# EasyEDA Pro project 3SE_24_Power_Rune.eprj, board 深大PCB参考 (continued)
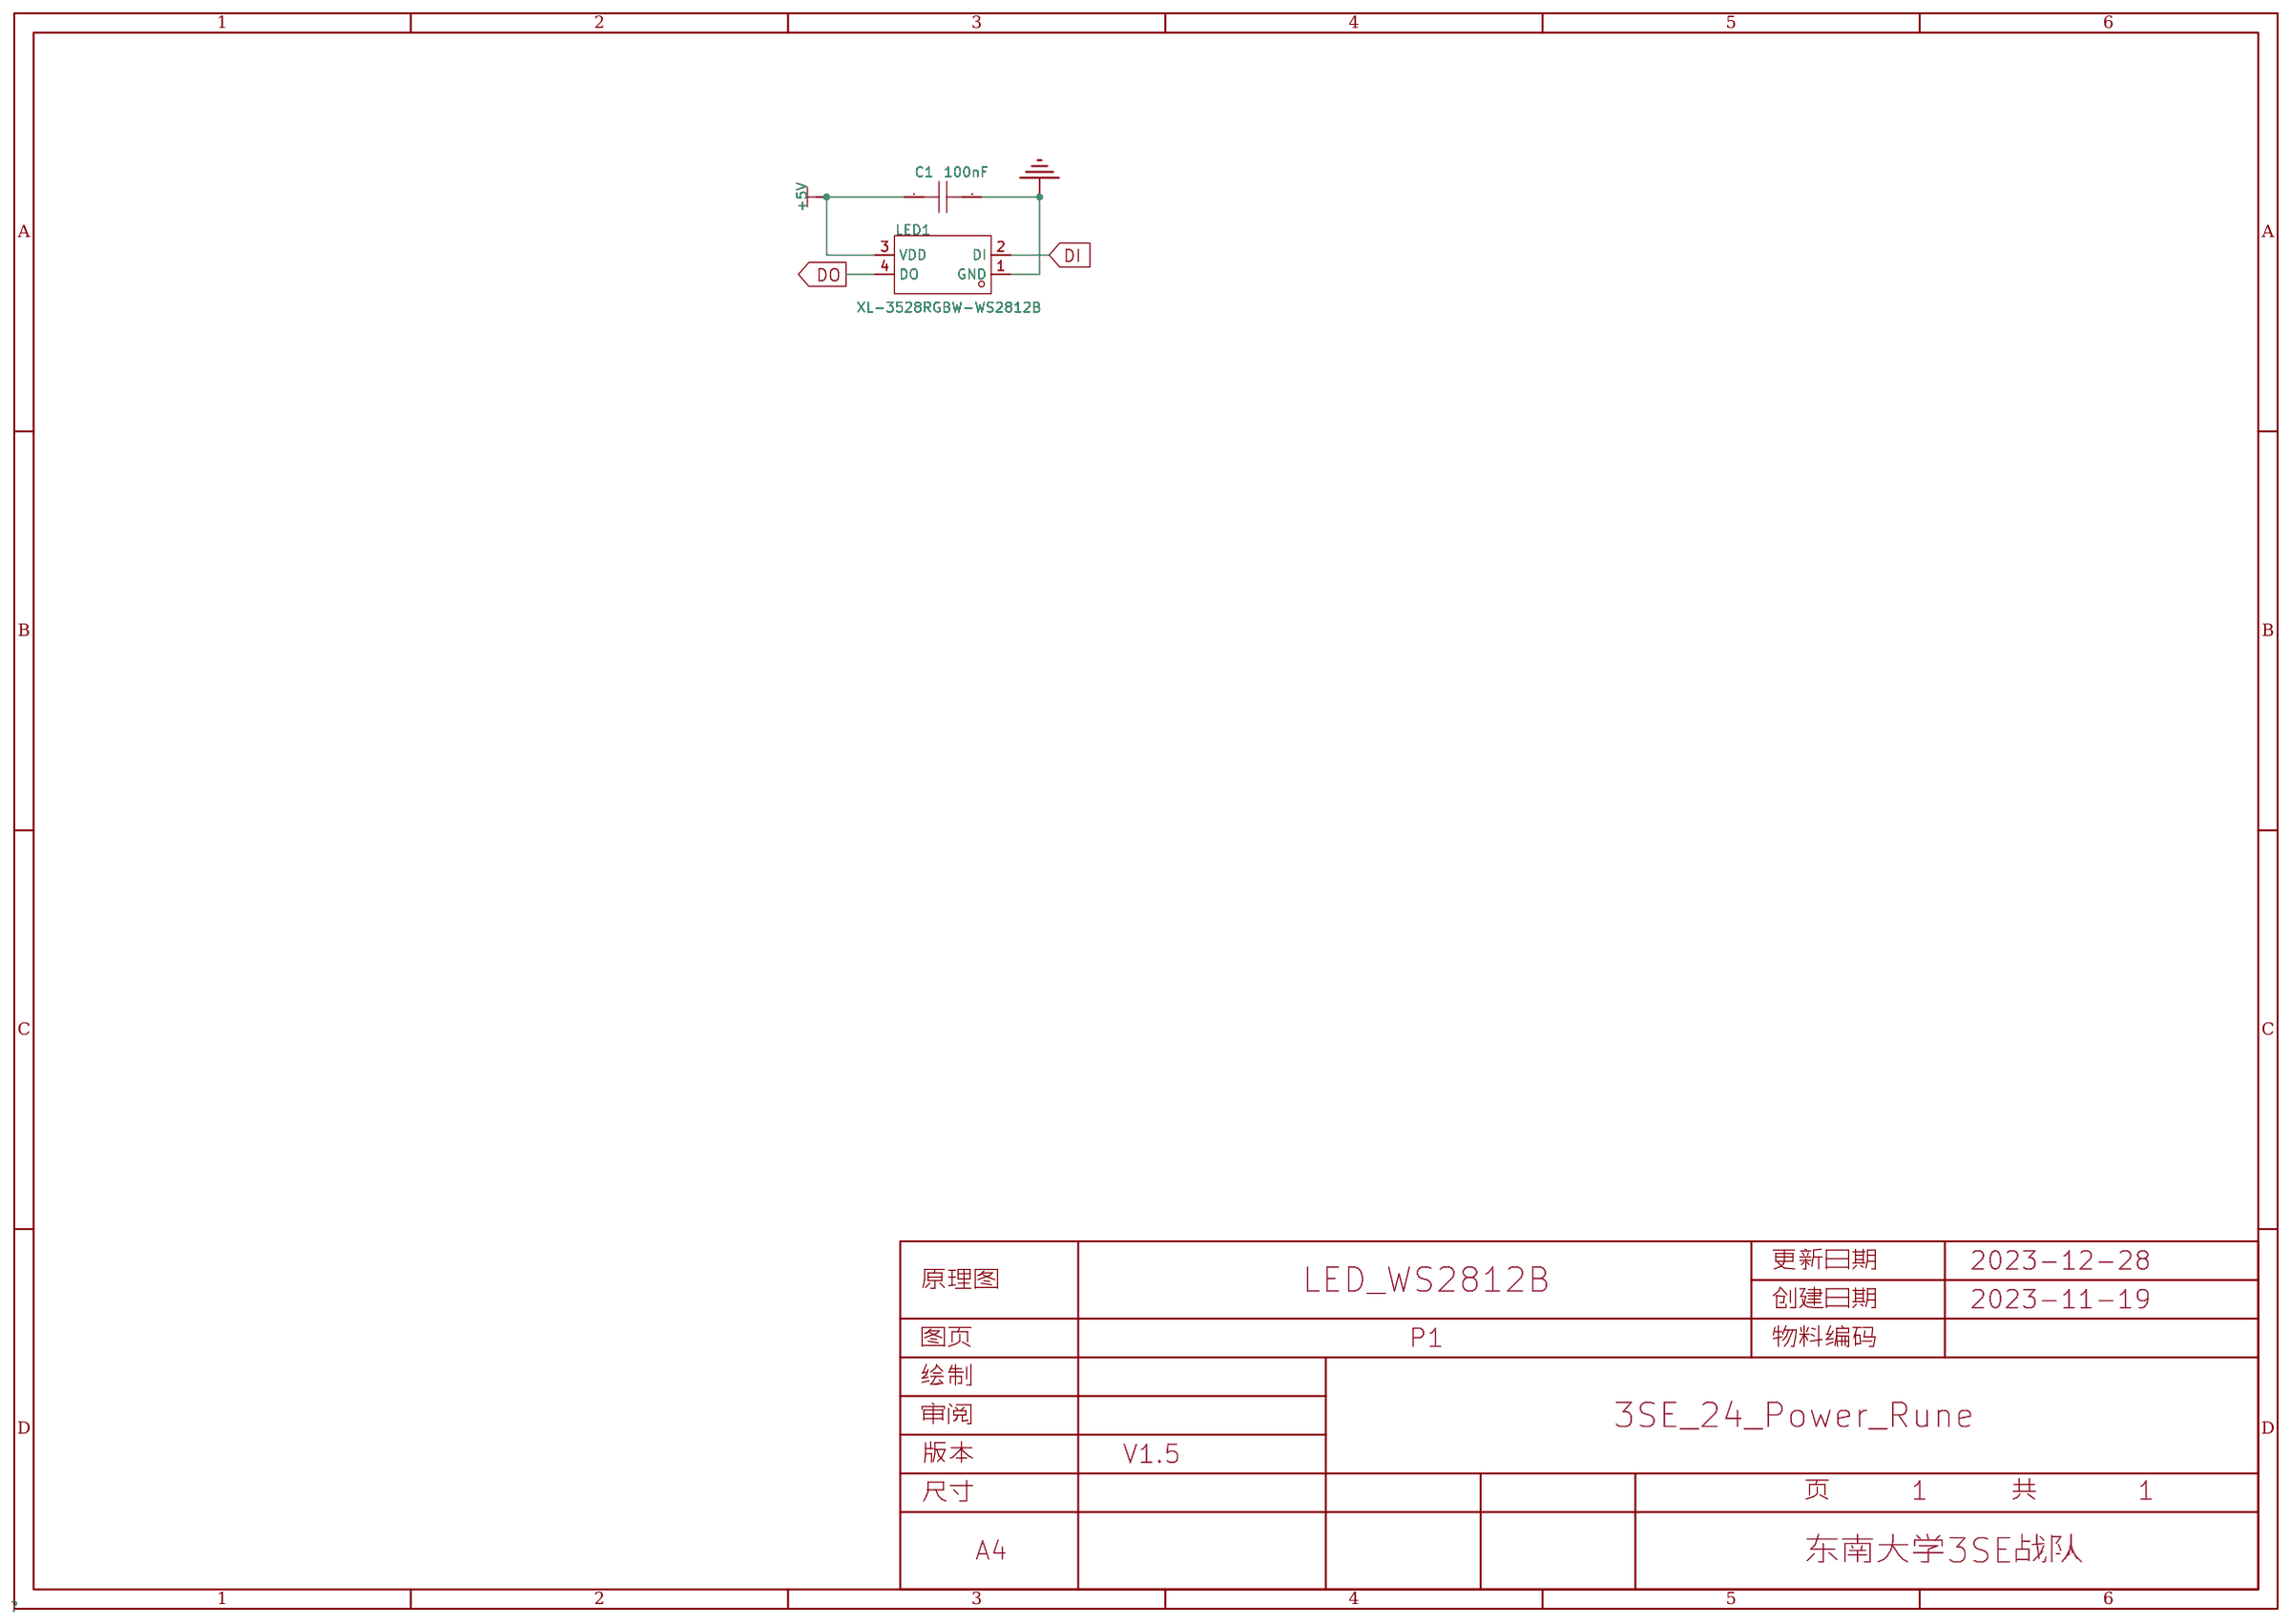
[diagram p0: schematic sheet]
## Placement (name value [footprint] x y rotation side) (continued)
J10  -  [GH1.25-LS-2P]  164.72 282.19 195 bottom
J11  -  [GH1.25-LS-2P]  161.42 296.93 195 bottom
J12  -  [GH1.25-LS-2P]  157.5 310.76 195 bottom
J13  -  [GH1.25-LS-2P]  154.05 325.25 195 bottom
J14  -  [XT30M]  27.81 216.15 270 bottom
J15  -  [XT30M]  27.81 173.74 90 bottom
J17  -  [XT30M]  341 194.69 90 bottom
J18  -  [GH1.25_12P]  340.74 214.25 270 bottom
NOREF  -  [Pad_ie460]  306.42 318.26 180 top
NOREF#2  -  [Pad_ie430]  274.52 102.17 270 top
NOREF#3  -  [Pad_ie452]  210.92 218.77 0 top
NOREF#4  -  [Pad_ie442]  157.92 218.77 90 top
NOREF#5  -  [Pad_ie441]  168.52 208.17 90 top
NOREF#6  -  [Pad_ie453]  221.52 229.47 0 top
NOREF#7  -  [Pad_ie425]  126.12 133.97 180 top
NOREF#8  -  [Pad_ie435]  200.32 176.37 270 top
NOREF#9  -  [Pad_ie447]  104.9 271.27 90 top
NOREF#10  -  [Pad_ie426]  136.72 144.57 180 top
NOREF#11  -  [Pad_ie421]  83.72 91.47 180 top
NOREF#12  -  [Pad_ie431]  264.16 112.4 270 top
NOREF#13  -  [Pad_ie420]  66.42 60.27 180 top
NOREF#14  -  [Pad_ie434]  184.42 192.27 0 top
NOREF#15  -  [Pad_ie432]  157.73 165.35 180 top
NOREF#16  -  [Pad_ie454]  232.12 239.97 0 top
NOREF#17  -  [Pad_ie449]  83.72 292.97 180 top
NOREF#18  -  [Pad_ie427]  147.32 155.07 180 top
NOREF#19  -  [Pad_ie439]  242.72 133.97 270 top
NOREF#20  -  [Pad_ie457]  264.16 272.03 0 top
NOREF#21  -  [Pad_ie429]  285.12 91.57 0 top
NOREF#22  -  [Pad_ie440]  253.32 123.37 270 top
NOREF#23  -  [Pad_ie461]  184.42 192.27 180 top
NOREF#24  -  [Pad_ie428]  302.42 60.27 180 top
NOREF#25  -  [Pad_ie456]  253.32 261.21 0 top
NOREF#26  -  [Pad_ie446]  115.52 261.17 90 top
NOREF#27  -  [Pad_ie448]  94.32 282.37 90 top
NOREF#28  -  [Pad_ie450]  62.42 318.26 180 top
NOREF#29  -  [Pad_ie424]  115.52 123.33 180 top
NOREF#30  -  [Pad_ie444]  137.03 240.28 90 top
NOREF#31  -  [Pad_ie459]  285.12 293.06 0 top
NOREF#32  -  [Pad_ie422]  94.32 102.27 180 top
NOREF#33  -  [Pad_ie436]  210.92 165.77 270 top
NOREF#34  -  [Pad_ie455]  242.72 250.57 0 top
NOREF#35  -  [Pad_ie443]  147.32 229.37 90 top
NOREF#36  -  [Pad_ie458]  274.52 282.27 0 top
NOREF#37  -  [Pad_ie445]  126.12 250.57 90 top
NOREF#38  -  [Pad_ie437]  221.52 155.17 270 top
NOREF#39  -  [Pad_ie433]  168.52 176.37 180 top
NOREF#40  -  [Pad_ie438]  232.12 144.57 270 top
NOREF#41  -  [Pad_ie423]  104.39 113.28 180 top
NOREF#42  -  [Pad_ie451]  200.32 208.17 0 top
SW1  -  [SW-TH_MICROSWITCH]  181.23 199.26 180 top
SW2  -  [SW-TH_MICROSWITCH]  187.83 184.91 0 top
SW3  -  [SW-TH_MICROSWITCH]  180.21 213.23 195 top
SW4  -  [SW-TH_MICROSWITCH]  165.23 188.34 285 top
SW5  -  [SW-TH_MICROSWITCH]  188.62 171.3 15 top
SW6  -  [SW-TH_MICROSWITCH]  205.39 196.47 105 top
SW7  -  [SW-TH_MICROSWITCH]  197.23 159.26 15 top
SW9  -  [SW-TH_MICROSWITCH]  172.34 224.66 195 top
SW10  -  [SW-TH_MICROSWITCH]  217.04 205.11 105 top
SW11  -  [SW-TH_MICROSWITCH]  168.27 239.65 195 top
SW12  -  [SW-TH_MICROSWITCH]  136.65 175.77 285 top
SW13  -  [SW-TH_MICROSWITCH]  200.79 144.65 15 top
SW14  -  [SW-TH_MICROSWITCH]  232.16 207.65 105 top
SW15  -  [SW-TH_MICROSWITCH]  164.97 254.13 195 top
SW16  -  [SW-TH_MICROSWITCH]  121.54 172.47 285 top
SW17  -  [SW-TH_MICROSWITCH]  204.39 130.64 15 top
SW18  -  [SW-TH_MICROSWITCH]  246.76 212.09 105 top
SW19  -  [SW-TH_MICROSWITCH]  161.29 268.86 195 top
SW20  -  [SW-TH_MICROSWITCH]  107.06 168.53 285 top
SW21  -  [SW-TH_MICROSWITCH]  206.8 115.65 15 top
SW22  -  [SW-TH_MICROSWITCH]  261.62 215.01 105 top
SW23  -  [SW-TH_MICROSWITCH]  157.48 284.61 195 top
SW24  -  [SW-TH_MICROSWITCH]  92.07 164.97 285 top
SW25  -  [SW-TH_MICROSWITCH]  210.36 101.3 15 top
SW26  -  [SW-TH_MICROSWITCH]  275.72 218.57 105 top
SW27  -  [SW-TH_MICROSWITCH]  154.18 299.34 195 top
SW28  -  [SW-TH_MICROSWITCH]  78.36 161.54 285 top
SW29  -  [SW-TH_MICROSWITCH]  214.3 86.44 15 top
SW30  -  [SW-TH_MICROSWITCH]  290.32 222.63 105 top
SW31  -  [SW-TH_MICROSWITCH]  150.24 313.18 195 top
SW32  -  [SW-TH_MICROSWITCH]  62.99 158.5 285 top
SW33  -  [SW-TH_MICROSWITCH]  217.93 71.88 15 top
SW34  -  [SW-TH_MICROSWITCH]  306.07 226.19 105 top
SW35  -  [SW-TH_MICROSWITCH]  146.81 327.66 195 top
SW36  -  [SW-TH_MICROSWITCH]  48.51 154.69 285 top
SW37  -  [SW-TH_MICROSWITCH]  221.36 57.66 15 top
SW38  -  [SW-TH_MICROSWITCH]  319.79 229.36 105 top

## Footprints (pads in the part's own frame, mm; a bottom-side part is the same pattern mirrored in y, then rotated)
C_0603
  rect 0.9x1 smd: 1(-0.85,0) 2(0.85,0)
C_0603#2
  rect 0.9x1 smd: 1(-0.85,0) 2(0.85,0)
GH1.25-LS-2P
  rect 0.6x1.702 smd: 1(0.625,1.6) 2(-0.625,1.6)
  rect 1.3x3 smd: 3(-2.575,-1.6) 4(2.575,-1.6)
GH1.25_12P
  rect 0.6x1.7 smd: 1(-6.875,1.675) 2(-5.625,1.675) 3(-4.375,1.675) 4(-3.125,1.675) 5(-1.875,1.675) 6(-0.625,1.675) 7(0.625,1.675) 8(1.875,1.675) 9(3.125,1.675) 10(4.375,1.675) 11(5.625,1.675) 12(6.875,1.675)
  rect 1x2.8 smd: 14(8.726,-1.675) 15(-8.726,-1.675)
LED-SMD_4P-L5.0-W5.0-TL_WS2812B-B
  rect 1.5x1 smd: 1(-2.45,1.65) 2(-2.45,-1.65) 3(2.45,-1.65) 4(2.45,1.65)
LED-SMD_4P-L5.0-W5.0-TL_WS2812B-B#2
  rect 1.5x1 smd: 1(-2.45,1.65) 2(-2.45,-1.65) 3(2.45,-1.65) 4(2.45,1.65)
LED-SMD_4P-L5.0-W5.0-TL_WS2812B-B#3
  rect 1.5x1 smd: 1(-2.45,1.65) 2(-2.45,-1.65) 3(2.45,-1.65) 4(2.45,1.65)
LED-SMD_4P-L5.0-W5.0-TL_WS2812B-B#4
  rect 1.5x1 smd: 1(-2.45,1.65) 2(-2.45,-1.65) 3(2.45,-1.65) 4(2.45,1.65)
LED-SMD_4P-L5.0-W5.0-TL_WS2812B-B#5
  rect 1.5x1 smd: 1(-2.45,1.65) 2(-2.45,-1.65) 3(2.45,-1.65) 4(2.45,1.65)
Pad_ie420
  round 6 hole 5.2: 1(0,0)
Pad_ie421
  round 6 hole 5.2: 1(0,0)
Pad_ie422
  round 6 hole 5.2: 1(0,0)
Pad_ie423
  round 6 hole 5.2: 1(0,0)
Pad_ie424
  round 6 hole 5.2: 1(0,0)
Pad_ie425
  round 6 hole 5.2: 1(0,0)
Pad_ie426
  round 6 hole 5.2: 1(0,0)
Pad_ie427
  round 6 hole 5.2: 1(0,0)
Pad_ie428
  round 6 hole 5.2: 1(0,0)
Pad_ie429
  round 6 hole 5.2: 1(0,0)
Pad_ie430
  round 6 hole 5.2: 1(0,0)
Pad_ie431
  round 6 hole 5.2: 1(0,0)
Pad_ie432
  round 6 hole 5.2: 1(0,0)
Pad_ie433
  round 6 hole 5.2: 1(0,0)
Pad_ie434
  round 6 hole 5.2: 1(0,0)
Pad_ie435
  round 6 hole 5.2: 1(0,0)
Pad_ie436
  round 6 hole 5.2: 1(0,0)
Pad_ie437
  round 6 hole 5.2: 1(0,0)
Pad_ie438
  round 6 hole 5.2: 1(0,0)
Pad_ie439
  round 6 hole 5.2: 1(0,0)
Pad_ie440
  round 6 hole 5.2: 1(0,0)
Pad_ie441
  round 6 hole 5.2: 1(0,0)
Pad_ie442
  round 6 hole 5.2: 1(0,0)
Pad_ie443
  round 6 hole 5.2: 1(0,0)
Pad_ie444
  round 6 hole 5.2: 1(0,0)
Pad_ie445
  round 6 hole 5.2: 1(0,0)
Pad_ie446
  round 6 hole 5.2: 1(0,0)
Pad_ie447
  round 6 hole 5.2: 1(0,0)
Pad_ie448
  round 6 hole 5.2: 1(0,0)
Pad_ie449
  round 6 hole 5.2: 1(0,0)
Pad_ie450
  round 6 hole 5.2: 1(0,0)
Pad_ie451
  round 6 hole 5.2: 1(0,0)
Pad_ie452
  round 6 hole 5.2: 1(0,0)
Pad_ie453
  round 6 hole 5.2: 1(0,0)
Pad_ie454
  round 6 hole 5.2: 1(0,0)
Pad_ie455
  round 6 hole 5.2: 1(0,0)
Pad_ie456
  round 6 hole 5.2: 1(0,0)
Pad_ie457
  round 6 hole 5.2: 1(0,0)
Pad_ie458
  round 6 hole 5.2: 1(0,0)
Pad_ie459
  round 6 hole 5.2: 1(0,0)
Pad_ie460
  round 6 hole 5.2: 1(0,0)
Pad_ie461
  round 8 smd far side: tdr(0,0)
SW-TH_MICROSWITCH
  oval 2.2x1.5 hole 1.8x1: 1(-5.079,0) 2(0.001,0) 3(5.081,0)
XT30M
  round 3.5 hole 2.6: 1(-2.5,0) 2(2.5,0)

## Nets
GND: .2 C1.2 C2.2 C3.2 C4.2 C5.2 C6.2 C7.2 C8.2 C9.2 C10.2 C11.2 C12.2 C13.2 C14.2 C15.2 C16.2 C17.2 C18.2 C19.2 C20.2 C21.2 C22.2 C23.2 C24.2 C25.2 C26.2 C27.2 C28.2 C29.2 C30.2 C31.2 C32.2 C33.2 C34.2 C35.2 C36.2 C37.2 C38.2 C39.2 C40.2 C41.2 C42.2 C43.2 C44.2 C45.2 C46.2 C47.2 C48.2 C49.2 C50.2 C51.2 C52.2 C53.2 C54.2 C55.2 C56.2 C57.2 C58.2 C59.2 C60.2 C61.2 C62.2 C63.2 C64.2 C65.2 C66.2 C67.2 C68.2 C69.2 C70.2 C71.2 C72.2 C73.2 C74.2 C75.2 C76.2 C77.2 C78.2 C79.2 C80.2 C81.2 C82.2 C83.2 C84.2 C85.2 C86.2 C87.2 C88.2 C89.2 C90.2 C91.2 C92.2 C93.2 C94.2 C95.2 C96.2 C97.2 C98.2 C99.2 C100.2 C101.2 C102.2 C103.2 C104.2 C105.2 C106.2 C107.2 C108.2 C109.2 C110.2 C111.2 C112.2 C113.2 C114.2 C115.2 C116.2 C117.2 C118.2 C119.2 C120.2 C121.2 C122.2 C123.2 C124.2 C125.2 C126.2 C127.2 C128.2 C129.2 C130.2 C131.2 C132.2 C133.2 C134.2 C135.2 C136.2 C137.2 C138.2 C139.2 C140.2 C141.2 C142.2 C143.2 C144.2 C145.2 C146.2 C147.2 C148.2 C149.2 C150.2 C151.2 C152.2 C153.2 C154.2 C155.2 C156.2 C157.2 C158.2 C159.2 C160.2 C161.2 C162.2 C163.2 C164.2 C165.2 C166.2 C167.2 C168.2 C169.2 C170.2 C171.2 C172.2 C173.2 C174.2 C175.2 C176.2 C177.2 C178.2 C179.2 C180.2 C181.2 C182.2 C183.2 C184.2 C185.2 C186.2 C187.2 C188.2 C189.2 C190.2 C191.2 C192.2 C193.2 C194.2 C195.2 C196.2 C197.2 C198.2 C199.2 C200.2 C201.2 C202.2 C203.2 C204.2 C205.2 C206.2 C207.2 C208.2 C209.2 C210.2 C211.2 C212.2 C213.2 C214.2 C215.2 C216.2 C217.2 C218.2 C219.2 C220.2 C221.2 C222.2 C223.2 C224.2 C225.2 C226.2 C227.2 C228.2 C229.2 C230.2 C231.2 C232.2 C233.2 C234.2 C235.2 C236.2 C237.2 C238.2 C239.2 C240.2 C241.2 C242.2 C243.2 C244.2 C245.2 C246.2 C247.2 C248.2 C249.2 C250.2 C251.2 C252.2 C253.2 C254.2 C255.2 C256.2 C257.2 C258.2 C259.2 C260.2 C261.2 C262.2 C263.2 C264.2 C265.2 C266.2 C267.2 C268.2 C269.2 C270.2 C271.2 C272.2 C273.2 C274.2 C275.2 C276.2 C277.2 C278.2 C279.2 C280.2 C281.2 C282.2 C283.2 C284.2 C285.2 C286.2 C287.2 C288.2 C289.2 C290.2 C291.2 C292.2 C293.2 C294.2 C295.2 C296.2 C297.2 C298.2 C299.2 C300.2 C301.2 C302.2 C303.2 C304.2 C305.2 C306.2 C307.2 C308.2 C309.2 C310.2 C311.2 C312.2 C313.2 C314.2 C315.2 C316.2 C317.2 C318.2 C319.2 C320.2 C321.2 C322.2 C323.2 C324.2 C325.2 C326.2 C327.2 C328.2 C329.2 C330.2 C331.2 C332.2 C333.2 C334.2 C335.2 C336.2 C337.2 C338.2 C339.2 C340.2 C341.2 C342.2 C343.2 C344.2 C345.2 C346.2 C347.2 C348.2 C349.2 C350.2 C351.2 C352.2 C353.2 C354.2 C355.2 C356.2 C357.2 C358.2 C359.2 C360.2 C361.2 C362.2 C363.2 C364.2 C365.2 C366.2 C367.2 C368.2 C369.2 C370.2 C371.2 C372.2 C373.2 C374.2 C375.2 C376.2 C377.2 C378.2 C379.2 C380.2 C381.2 C382.2 C383.2 C384.2 C385.2 C386.2 C387.2 C388.2 C389.2 C390.2 C391.2 C392.2 C393.2 C394.2 C395.2 C396.2 C397.2 C398.2 C399.2 C400.2 C401.2 C402.2 C403.2 C404.2 C405.2 C406.2 C407.2 C408.2 C409.2 C410.2 C411.2 C412.2 C413.2 C414.2 C415.2 C416.2 C417.2 C418.2 C419.2 C420.2 C421.2 C422.2 C423.2 C424.2 C425.2 C426.2 C427.2 C428.2 C429.2 C430.2 C431.2 C432.2 C433.2 C434.2 C435.2 C436.2 C437.2 C438.2 C439.2 C440.2 C441.2 C442.2 C443.2 C444.2 C445.2 C446.2 C447.2 C448.2 C449.2 C450.2 C451.2 C452.2 D1.3 D2.3 D3.3 D4.3 D5.3 D6.3 D7.3 D8.3 D9.3 D10.3 D11.3 D12.3 D13.3 D14.3 D15.3 D16.3 D17.3 D18.3 D19.3 D20.3 D21.3 D22.3 D23.3 D24.3 D25.3 D26.3 D27.3 D28.3 D29.3 D30.3 D31.3 D32.3 D33.3 D34.3 D35.3 D36.3 D37.3 D38.3 D39.3 D40.3 D41.3 D42.3 D43.3 D44.3 D45.3 D46.3 D47.3 D48.3 D49.3 D50.3 D51.3 D52.3 D53.3 D54.3 D55.3 D56.3 D57.3 D58.3 D59.3 D60.3 D61.3 D62.3 D63.3 D64.3 D65.3 D66.3 D67.3 D68.3 D69.3 D70.3 D71.3 D72.3 D73.3 D74.3 D75.3 D76.3 D77.3 D78.3 D79.3 D80.3 D81.3 D82.3 D83.3 D84.3 D85.3 D86.3 D87.3 D88.3 D89.3 D90.3 D91.3 D92.3 D93.3 D94.3 D95.3 D96.3 D97.3 D98.3 D99.3 D100.3 D101.3 D102.3 D103.3 D104.3 D105.3 D106.3 D107.3 D108.3 D109.3 D110.3 D111.3 D112.3 D113.3 D114.3 D115.3 D116.3 D117.3 D118.3 D119.3 D120.3 D121.3 D122.3 D123.3 D124.3 D125.3 D126.3 D127.3 D128.3 D129.3 D130.3 D131.3 D132.3 D133.3 D134.3 D135.3 D136.3 D137.3 D138.3 D139.3 D140.3 D141.3 D142.3 D143.3 D144.3 D145.3 D146.3 D147.3 D148.3 D149.3 D150.3 D151.3 D152.3 D153.3 D154.3 D155.3 D156.3 D157.3 D158.3 D159.3 D160.3 D161.3 D162.3 D163.3 D164.3 D165.3 D166.3 D167.3 D168.3 D169.3 D170.3 D171.3 D172.3 D173.3 D174.3 D175.3 D176.3 D177.3 D178.3 D179.3 D180.3 D181.3 D182.3 D183.3 D184.3 D185.3 D186.3 D187.3 D188.3 D189.3 D190.3 D191.3 D192.3 D193.3 D194.3 D195.3 D196.3 D197.3 D198.3 D199.3 D200.3 D201.3 D202.3 D203.3 D204.3 D205.3 D206.3 D207.3 D208.3 D209.3 D210.3 D211.3 D212.3 D213.3 D214.3 D215.3 D216.3 D217.3 D218.3 D219.3 D220.3 D221.3 D222.3 D223.3 D224.3 D225.3 D226.3 D227.3 D228.3 D229.3 D230.3 D231.3 D232.3 D233.3 D234.3 D235.3 D236.3 D237.3 D238.3 D239.3 D240.3 D241.3 D242.3 D243.3 D244.3 D245.3 D246.3 D247.3 D248.3 D249.3 D250.3 D251.3 D252.3 D253.3 D254.3 D255.3 D256.3 D257.3 D258.3 D259.3 D260.3 D261.3 D262.3 D263.3 D264.3 D265.3 D266.3 D267.3 D268.3 D269.3 D270.3 D271.3 D272.3 D273.3 D274.3 D275.3 D276.3 D277.3 D278.3 D279.3 D280.3 D281.3 D282.3 D283.3 D284.3 D285.3 D286.3 D287.3 D288.3 D289.3 D290.3 D291.3 D292.3 D293.3 D294.3 D295.3 D296.3 D297.3 D298.3 D299.3 D300.3 D301.3 D302.3 D303.3 D304.3 D305.3 D306.3 D307.3 D308.3 D309.3 D310.3 D311.3 D312.3 D313.3 D314.3 D315.3 D316.3 D317.3 D318.3 D319.3 D320.3 D321.3 D322.3 D323.3 D324.3 D325.3 D326.3 D327.3 D328.3 D329.3 D330.3 D331.3 D332.3 D333.3 D334.3 D335.3 D336.3 D337.3 D338.3 D339.3 D340.3 D341.3 D342.3 D343.3 D344.3 D345.3 D346.3 D347.3 D348.3 D349.3 D350.3 D351.3 D352.3 D353.3 D354.3 D355.3 D356.3 D357.3 D358.3 D359.3 D360.3 D361.3 D362.3 D363.3 D364.3 D365.3 D366.3 D367.3 D368.3 D369.3 D370.3 D371.3 D372.3 D373.3 D374.3 D375.3 D376.3 D377.3 D378.3 D379.3 D380.3 D381.3 D382.3 D383.3 D384.3 D385.3 D386.3 D387.3 D388.3 D389.3 D390.3 D391.3 D392.3 D393.3 D394.3 D395.3 D396.3 D397.3 D398.3 D399.3 D400.3 D401.3 D402.3 D403.3 D404.3 D405.3 D406.3 D407.3 D408.3 D409.3 D410.3 D411.3 D412.3 D413.3 D414.3 D415.3 D416.3 D417.3 D418.3 D419.3 D420.3 D421.3 D422.3 D423.3 D424.3 D425.3 D426.3 D427.3 D428.3 D429.3 D430.3 D431.3 D432.3 D433.3 D434.3 D435.3 D436.3 D437.3 D438.3 D439.3 D440.3 D441.3 D442.3 D443.3 D444.3 D445.3 D446.3 D447.3 D448.3 D449.3 D450.3 D451.3 D452.3 J1.2 J1.3 J1.4 J2.2 J2.3 J2.4 J3.2 J3.3 J3.4 J4.2 J4.3 J4.4 J5.2 J5.3 J5.4 J6.2 J6.3 J6.4 J7.2 J7.3 J7.4 J8.2 J8.3 J8.4 J9.2 J9.3 J9.4 J10.2 J10.3 J10.4 J11.2 J11.3 J11.4 J12.2 J12.3 J12.4 J13.2 J13.3 J13.4 J14.1 J15.1 J17.1 J18.3 J18.12 J18.14 J18.15 SW1.2 SW2.2 SW3.2 SW4.2 SW5.2 SW6.2 SW7.2 SW9.2 SW10.2 SW11.2 SW12.2 SW13.2 SW14.2 SW15.2 SW16.2 SW17.2 SW18.2 SW19.2 SW20.2 SW21.2 SW22.2 SW23.2 SW24.2 SW25.2 SW26.2 SW27.2 SW28.2 SW29.2 SW30.2 SW31.2 SW32.2 SW33.2 SW34.2 SW35.2 SW36.2 SW37.2 SW38.2
VCC: C1.1 C2.1 C3.1 C4.1 C5.1 C6.1 C7.1 C8.1 C9.1 C10.1 C11.1 C12.1 C13.1 C14.1 C15.1 C16.1 C17.1 C18.1 C19.1 C20.1 C21.1 C22.1 C23.1 C24.1 C25.1 C26.1 C27.1 C28.1 C29.1 C30.1 C31.1 C32.1 C33.1 C34.1 C35.1 C36.1 C37.1 C38.1 C39.1 C40.1 C41.1 C42.1 C43.1 C44.1 C45.1 C46.1 C47.1 C48.1 C49.1 C50.1 C51.1 C52.1 C53.1 C54.1 C55.1 C56.1 C57.1 C58.1 C59.1 C60.1 C61.1 C62.1 C63.1 C64.1 C65.1 C66.1 C67.1 C68.1 C69.1 C70.1 C71.1 C72.1 C73.1 C74.1 C75.1 C76.1 C77.1 C78.1 C79.1 C80.1 C81.1 C82.1 C83.1 C84.1 C85.1 C86.1 C87.1 C88.1 C89.1 C90.1 C91.1 C92.1 C93.1 C94.1 C95.1 C96.1 C97.1 C98.1 C99.1 C100.1 C101.1 C102.1 C103.1 C104.1 C105.1 C106.1 C107.1 C108.1 C109.1 C110.1 C111.1 C112.1 C113.1 C114.1 C115.1 C116.1 C117.1 C118.1 C119.1 C120.1 C121.1 C122.1 C123.1 C124.1 C125.1 C126.1 C127.1 C128.1 C129.1 C130.1 C131.1 C132.1 C133.1 C134.1 C135.1 C136.1 C137.1 C138.1 C139.1 C140.1 C141.1 C142.1 C143.1 C144.1 C145.1 C146.1 C147.1 C148.1 C149.1 C150.1 C151.1 C152.1 C153.1 C154.1 C155.1 C156.1 C157.1 C158.1 C159.1 C160.1 C161.1 C162.1 C163.1 C164.1 C165.1 C166.1 C167.1 C168.1 C169.1 C170.1 C171.1 C172.1 C173.1 C174.1 C175.1 C176.1 C177.1 C178.1 C179.1 C180.1 C181.1 C182.1 C183.1 C184.1 C185.1 C186.1 C187.1 C188.1 C189.1 C190.1 C191.1 C192.1 C193.1 C194.1 C195.1 C196.1 C197.1 C198.1 C199.1 C200.1 C201.1 C202.1 C203.1 C204.1 C205.1 C206.1 C207.1 C208.1 C209.1 C210.1 C211.1 C212.1 C213.1 C214.1 C215.1 C216.1 C217.1 C218.1 C219.1 C220.1 C221.1 C222.1 C223.1 C224.1 C225.1 C226.1 C227.1 C228.1 C229.1 C230.1 C231.1 C232.1 C233.1 C234.1 C235.1 C236.1 C237.1 C238.1 C239.1 C240.1 C241.1 C242.1 C243.1 C244.1 C245.1 C246.1 C247.1 C248.1 C249.1 C250.1 C251.1 C252.1 C253.1 C254.1 C255.1 C256.1 C257.1 C258.1 C259.1 C260.1 C261.1 C262.1 C263.1 C264.1 C265.1 C266.1 C267.1 C268.1 C269.1 C270.1 C271.1 C272.1 C273.1 C274.1 C275.1 C276.1 C277.1 C278.1 C279.1 C280.1 C281.1 C282.1 C283.1 C284.1 C285.1 C286.1 C287.1 C288.1 C289.1 C290.1 C291.1 C292.1 C293.1 C294.1 C295.1 C296.1 C297.1 C298.1 C299.1 C300.1 C301.1 C302.1 C303.1 C304.1 C305.1 C306.1 C307.1 C308.1 C309.1 C310.1 C311.1 C312.1 C313.1 C314.1 C315.1 C316.1 C317.1 C318.1 C319.1 C320.1 C321.1 C322.1 C323.1 C324.1 C325.1 C326.1 C327.1 C328.1 C329.1 C330.1 C331.1 C332.1 C333.1 C334.1 C335.1 C336.1 C337.1 C338.1 C339.1 C340.1 C341.1 C342.1 C343.1 C344.1 C345.1 C346.1 C347.1 C348.1 C349.1 C350.1 C351.1 C352.1 C353.1 C354.1 C355.1 C356.1 C357.1 C358.1 C359.1 C360.1 C361.1 C362.1 C363.1 C364.1 C365.1 C366.1 C367.1 C368.1 C369.1 C370.1 C371.1 C372.1 C373.1 C374.1 C375.1 C376.1 C377.1 C378.1 C379.1 C380.1 C381.1 C382.1 C383.1 C384.1 C385.1 C386.1 C387.1 C388.1 C389.1 C390.1 C391.1 C392.1 C393.1 C394.1 C395.1 C396.1 C397.1 C398.1 C399.1 C400.1 C401.1 C402.1 C403.1 C404.1 C405.1 C406.1 C407.1 C408.1 C409.1 C410.1 C411.1 C412.1 C413.1 C414.1 C415.1 C416.1 C417.1 C418.1 C419.1 C420.1 C421.1 C422.1 C423.1 C424.1 C425.1 C426.1 C427.1 C428.1 C429.1 C430.1 C431.1 C432.1 C433.1 C434.1 C435.1 C436.1 C437.1 C438.1 C439.1 C440.1 C441.1 C442.1 C443.1 C444.1 C445.1 C446.1 C447.1 C448.1 C449.1 C450.1 C451.1 C452.1 D1.1 D2.1 D3.1 D4.1 D5.1 D6.1 D7.1 D8.1 D9.1 D10.1 D11.1 D12.1 D13.1 D14.1 D15.1 D16.1 D17.1 D18.1 D19.1 D20.1 D21.1 D22.1 D23.1 D24.1 D25.1 D26.1 D27.1 D28.1 D29.1 D30.1 D31.1 D32.1 D33.1 D34.1 D35.1 D36.1 D37.1 D38.1 D39.1 D40.1 D41.1 D42.1 D43.1 D44.1 D45.1 D46.1 D47.1 D48.1 D49.1 D50.1 D51.1 D52.1 D53.1 D54.1 D55.1 D56.1 D57.1 D58.1 D59.1 D60.1 D61.1 D62.1 D63.1 D64.1 D65.1 D66.1 D67.1 D68.1 D69.1 D70.1 D71.1 D72.1 D73.1 D74.1 D75.1 D76.1 D77.1 D78.1 D79.1 D80.1 D81.1 D82.1 D83.1 D84.1 D85.1 D86.1 D87.1 D88.1 D89.1 D90.1 D91.1 D92.1 D93.1 D94.1 D95.1 D96.1 D97.1 D98.1 D99.1 D100.1 D101.1 D102.1 D103.1 D104.1 D105.1 D106.1 D107.1 D108.1 D109.1 D110.1 D111.1 D112.1 D113.1 D114.1 D115.1 D116.1 D117.1 D118.1 D119.1 D120.1 D121.1 D122.1 D123.1 D124.1 D125.1 D126.1 D127.1 D128.1 D129.1 D130.1 D131.1 D132.1 D133.1 D134.1 D135.1 D136.1 D137.1 D138.1 D139.1 D140.1 D141.1 D142.1 D143.1 D144.1 D145.1 D146.1 D147.1 D148.1 D149.1 D150.1 D151.1 D152.1 D153.1 D154.1 D155.1 D156.1 D157.1 D158.1 D159.1 D160.1 D161.1 D162.1 D163.1 D164.1 D165.1 D166.1 D167.1 D168.1 D169.1 D170.1 D171.1 D172.1 D173.1 D174.1 D175.1 D176.1 D177.1 D178.1 D179.1 D180.1 D181.1 D182.1 D183.1 D184.1 D185.1 D186.1 D187.1 D188.1 D189.1 D190.1 D191.1 D192.1 D193.1 D194.1 D195.1 D196.1 D197.1 D198.1 D199.1 D200.1 D201.1 D202.1 D203.1 D204.1 D205.1 D206.1 D207.1 D208.1 D209.1 D210.1 D211.1 D212.1 D213.1 D214.1 D215.1 D216.1 D217.1 D218.1 D219.1 D220.1 D221.1 D222.1 D223.1 D224.1 D225.1 D226.1 D227.1 D228.1 D229.1 D230.1 D231.1 D232.1 D233.1 D234.1 D235.1 D236.1 D237.1 D238.1 D239.1 D240.1 D241.1 D242.1 D243.1 D244.1 D245.1 D246.1 D247.1 D248.1 D249.1 D250.1 D251.1 D252.1 D253.1 D254.1 D255.1 D256.1 D257.1 D258.1 D259.1 D260.1 D261.1 D262.1 D263.1 D264.1 D265.1 D266.1 D267.1 D268.1 D269.1 D270.1 D271.1 D272.1 D273.1 D274.1 D275.1 D276.1 D277.1 D278.1 D279.1 D280.1 D281.1 D282.1 D283.1 D284.1 D285.1 D286.1 D287.1 D288.1 D289.1 D290.1 D291.1 D292.1 D293.1 D294.1 D295.1 D296.1 D297.1 D298.1 D299.1 D300.1 D301.1 D302.1 D303.1 D304.1 D305.1 D306.1 D307.1 D308.1 D309.1 D310.1 D311.1 D312.1 D313.1 D314.1 D315.1 D316.1 D317.1 D318.1 D319.1 D320.1 D321.1 D322.1 D323.1 D324.1 D325.1 D326.1 D327.1 D328.1 D329.1 D330.1 D331.1 D332.1 D333.1 D334.1 D335.1 D336.1 D337.1 D338.1 D339.1 D340.1 D341.1 D342.1 D343.1 D344.1 D345.1 D346.1 D347.1 D348.1 D349.1 D350.1 D351.1 D352.1 D353.1 D354.1 D355.1 D356.1 D357.1 D358.1 D359.1 D360.1 D361.1 D362.1 D363.1 D364.1 D365.1 D366.1 D367.1 D368.1 D369.1 D370.1 D371.1 D372.1 D373.1 D374.1 D375.1 D376.1 D377.1 D378.1 D379.1 D380.1 D381.1 D382.1 D383.1 D384.1 D385.1 D386.1 D387.1 D388.1 D389.1 D390.1 D391.1 D392.1 D393.1 D394.1 D395.1 D396.1 D397.1 D398.1 D399.1 D400.1 D401.1 D402.1 D403.1 D404.1 D405.1 D406.1 D407.1 D408.1 D409.1 D410.1 D411.1 D412.1 D413.1 D414.1 D415.1 D416.1 D417.1 D418.1 D419.1 D420.1 D421.1 D422.1 D423.1 D424.1 D425.1 D426.1 D427.1 D428.1 D429.1 D430.1 D431.1 D432.1 D433.1 D434.1 D435.1 D436.1 D437.1 D438.1 D439.1 D440.1 D441.1 D442.1 D443.1 D444.1 D445.1 D446.1 D447.1 D448.1 D449.1 D450.1 D451.1 D452.1 J14.2 J15.2 J17.2
DIN1: D1.4 J1.1
DIN2: D89.4 J2.1
DIN3: D181.4 J3.1
DOUT1: D88.2
DOUT2: D180.2
DOUT3: D452.2
I: D356.2 D357.4
NETD1_2: D1.2 D2.4
NETD2_2: D2.2 D3.4
NETD3_2: D3.2 D4.4
NETD4_2: D4.2 D5.4
NETD5_2: D5.2 D6.4
NETD6_2: D6.2 D7.4
NETD7_2: D7.2 D8.4
NETD8_2: D8.2 D9.4
NETD9_2: D9.2 D10.4
NETD10_2: D10.2 D11.4
NETD11_2: D11.2 D12.4
NETD12_2: D12.2 D13.4
NETD13_2: D13.2 D14.4
NETD14_2: D14.2 D15.4
NETD15_2: D15.2 D16.4
NETD16_2: D16.2 D17.4
NETD17_2: D17.2 D18.4
NETD18_2: D18.2 D19.4
NETD19_2: D19.2 D20.4
NETD20_2: D20.2 D21.4
NETD21_2: D21.2 D22.4
NETD22_2: D22.2 D23.4
NETD23_2: D23.2 D24.4
NETD24_2: D24.2 D25.4
NETD25_2: D25.2 D26.4
NETD26_2: D26.2 D27.4
NETD27_2: D27.2 D28.4
NETD28_2: D28.2 D29.4
NETD29_2: D29.2 D30.4
NETD30_2: D30.2 D31.4
NETD31_2: D31.2 D32.4
NETD32_2: D32.2 D33.4
NETD33_2: D33.2 D34.4
NETD34_2: D34.2 D35.4
NETD35_2: D35.2 D36.4
NETD36_2: D36.2 D37.4
NETD37_2: D37.2 D38.4
NETD38_2: D38.2 D39.4
NETD39_2: D39.2 D40.4
NETD40_2: D40.2 D41.4
NETD41_2: D41.2 D42.4
NETD42_2: D42.2 D43.4
NETD43_2: D43.2 D44.4
NETD44_2: D44.2 D45.4
NETD45_2: D45.2 D46.4
NETD46_2: D46.2 D47.4
NETD47_2: D47.2 D48.4
NETD48_2: D48.2 D49.4
NETD49_2: D49.2 D50.4
NETD50_2: D50.2 D51.4
NETD51_2: D51.2 D52.4
NETD52_2: D52.2 D53.4
NETD53_2: D53.2 D54.4
NETD54_2: D54.2 D55.4
NETD55_2: D55.2 D56.4
NETD56_2: D56.2 D57.4
NETD57_2: D57.2 D58.4
NETD58_2: D58.2 D59.4
NETD59_2: D59.2 D60.4
NETD60_2: D60.2 D61.4
NETD61_2: D61.2 D62.4
NETD62_2: D62.2 D63.4
NETD63_2: D63.2 D64.4
NETD64_2: D64.2 D65.4
NETD65_2: D65.2 D66.4
NETD66_2: D66.2 D67.4
NETD67_2: D67.2 D68.4
NETD68_2: D68.2 D69.4
NETD69_2: D69.2 D70.4
NETD70_2: D70.2 D71.4
NETD71_2: D71.2 D72.4
NETD72_2: D72.2 D73.4
NETD73_2: D73.2 D74.4
NETD74_2: D74.2 D75.4
NETD75_2: D75.2 D76.4
NETD76_2: D76.2 D77.4
NETD77_2: D77.2 D78.4
NETD78_2: D78.2 D79.4
NETD79_2: D79.2 D80.4
NETD80_2: D80.2 D81.4
NETD81_2: D81.2 D82.4
NETD82_2: D82.2 D83.4
NETD83_2: D83.2 D84.4
NETD84_2: D84.2 D85.4
NETD85_2: D85.2 D86.4
NETD86_2: D86.2 D87.4
NETD87_2: D87.2 D88.4
NETD89_2: D89.2 D90.4
NETD90_2: D90.2 D91.4
NETD91_2: D91.2 D92.4
NETD92_2: D92.2 D93.4
NETD93_2: D93.2 D94.4
NETD94_2: D94.2 D95.4
NETD95_2: D95.2 D96.4
NETD96_2: D96.2 D97.4
NETD97_2: D97.2 D98.4
NETD98_2: D98.2 D99.4
NETD99_2: D99.2 D100.4
NETD100_2: D100.2 D101.4
NETD101_2: D101.2 D102.4
NETD102_2: D102.2 D103.4
NETD103_2: D103.2 D104.4
NETD104_2: D104.2 D105.4
NETD105_2: D105.2 D106.4
NETD106_2: D106.2 D107.4
NETD107_2: D107.2 D108.4
NETD108_2: D108.2 D109.4
NETD109_2: D109.2 D110.4
NETD110_2: D110.2 D111.4
NETD111_2: D111.2 D112.4
NETD112_2: D112.2 D113.4
NETD113_2: D113.2 D114.4
NETD114_2: D114.2 D115.4
NETD115_2: D115.2 D116.4
NETD116_2: D116.2 D117.4
NETD117_2: D117.2 D118.4
NETD118_2: D118.2 D119.4
NETD119_2: D119.2 D120.4
NETD120_2: D120.2 D121.4
NETD121_2: D121.2 D122.4
NETD122_2: D122.2 D123.4
NETD123_2: D123.2 D124.4
NETD124_2: D124.2 D125.4
NETD125_2: D125.2 D126.4
NETD126_2: D126.2 D127.4
NETD127_2: D127.2 D128.4
NETD128_2: D128.2 D129.4
NETD129_2: D129.2 D130.4
NETD130_2: D130.2 D131.4
NETD131_2: D131.2 D132.4
NETD132_2: D132.2 D133.4
NETD133_2: D133.2 D134.4
NETD134_2: D134.2 D135.4
NETD135_2: D135.2 D136.4
NETD136_2: D136.2 D137.4
NETD137_2: D137.2 D138.4
NETD138_2: D138.2 D139.4
NETD139_2: D139.2 D140.4
NETD140_2: D140.2 D141.4
NETD141_2: D141.2 D142.4
NETD142_2: D142.2 D143.4
NETD143_2: D143.2 D144.4
NETD144_2: D144.2 D145.4
NETD145_2: D145.2 D146.4
NETD146_2: D146.2 D147.4
NETD147_2: D147.2 D148.4
NETD148_2: D148.2 D149.4
NETD149_2: D149.2 D150.4
NETD150_2: D150.2 D151.4
NETD151_2: D151.2 D152.4
NETD152_2: D152.2 D153.4
NETD153_2: D153.2 D154.4
NETD154_2: D154.2 D155.4
NETD155_2: D155.2 D156.4
NETD156_2: D156.2 D157.4
NETD157_2: D157.2 D158.4
NETD158_2: D158.2 D159.4
NETD159_2: D159.2 D160.4
NETD160_2: D160.2 D161.4
NETD161_2: D161.2 D162.4
NETD162_2: D162.2 D163.4
NETD163_2: D163.2 D164.4
NETD164_2: D164.2 D165.4
NETD165_2: D165.2 D166.4
NETD166_2: D166.2 D167.4
NETD167_2: D167.2 D168.4
NETD168_2: D168.2 D169.4
NETD169_2: D169.2 D170.4
NETD170_2: D170.2 D171.4
NETD171_2: D171.2 D172.4
NETD172_2: D172.2 D173.4
NETD173_2: D173.2 D174.4
NETD174_2: D174.2 D175.4
NETD175_2: D175.2 D176.4
NETD176_2: D176.2 D177.4
NETD177_2: D177.2 D178.4
NETD178_2: D178.2 D179.4
NETD179_2: D179.2 D180.4
NETD181_2: D181.2 D182.4
NETD182_2: D182.2 D183.4
NETD183_2: D183.2 D184.4
NETD184_2: D184.2 D185.4
NETD185_2: D185.2 D186.4
NETD186_2: D186.2 D187.4
NETD187_2: D187.2 D188.4
NETD188_2: D188.2 D189.4
NETD189_2: D189.2 D190.4
NETD190_2: D190.2 D191.4
NETD191_2: D191.2 D192.4
NETD192_2: D192.2 D193.4
NETD193_2: D193.2 D194.4
NETD194_2: D194.2 D195.4
NETD195_2: D195.2 D196.4
NETD196_2: D196.2 D197.4
NETD197_2: D197.2 D198.4
NETD198_2: D198.2 D199.4
NETD199_2: D199.2 D200.4
NETD200_2: D200.2 D201.4
NETD201_2: D201.2 D202.4
NETD202_2: D202.2 D203.4
NETD203_2: D203.2 D204.4
NETD204_2: D204.2 D205.4
NETD205_2: D205.2 D206.4
NETD206_2: D206.2 D207.4
NETD207_2: D207.2 D208.4
NETD208_2: D208.2 D209.4
NETD209_2: D209.2 D210.4
NETD210_2: D210.2 D211.4
NETD211_2: D211.2 D212.4
NETD212_2: D212.2 D213.4
NETD213_2: D213.2 D214.4
NETD214_2: D214.2 D215.4
NETD215_2: D215.2 D216.4
NETD216_2: D216.2 D217.4
NETD217_2: D217.2 D218.4
NETD218_2: D218.2 D219.4
NETD219_2: D219.2 D220.4
NETD220_2: D220.2 D221.4
NETD221_2: D221.2 D222.4
NETD222_2: D222.2 D223.4
NETD223_2: D223.2 D224.4
NETD224_2: D224.2 D225.4
NETD225_2: D225.2 D226.4
NETD226_2: D226.2 D227.4
NETD227_2: D227.2 D228.4
NETD228_2: D228.2 D229.4
NETD229_2: D229.2 D230.4
NETD230_2: D230.2 D231.4
NETD231_2: D231.2 D232.4
NETD232_2: D232.2 D233.4
NETD233_2: D233.2 D234.4
NETD234_2: D234.2 D235.4
NETD235_2: D235.2 D236.4
NETD236_2: D236.2 D237.4
NETD237_2: D237.2 D238.4
NETD238_2: D238.2 D239.4
NETD239_2: D239.2 D240.4
NETD240_2: D240.2 D241.4
NETD241_2: D241.2 D242.4
NETD242_2: D242.2 D243.4
NETD243_2: D243.2 D244.4
NETD244_2: D244.2 D245.4
NETD245_2: D245.2 D246.4
NETD246_2: D246.2 D247.4
NETD247_2: D247.2 D248.4
NETD248_2: D248.2 D249.4
NETD249_2: D249.2 D250.4
NETD250_2: D250.2 D251.4
NETD251_2: D251.2 D252.4
NETD252_2: D252.2 D253.4
NETD253_2: D253.2 D254.4
NETD254_2: D254.2 D255.4
NETD255_2: D255.2 D256.4
NETD256_2: D256.2 D257.4
NETD257_2: D257.2 D258.4
NETD258_2: D258.2 D259.4
NETD259_2: D259.2 D260.4
NETD260_2: D260.2 D261.4
NETD261_2: D261.2 D262.4
NETD262_2: D262.2 D263.4